# EasyEDA Pro project 智能车.eprj, schematic 霍尔停车检测
Create Date: 2023-10-08; Page Name: P1; Project Name: 智能车; Schematic Name: 霍尔停车检测; Update Date: 2023-10-08; Company: 嘉立创EDA; Page Size: A4; Version: V1.0
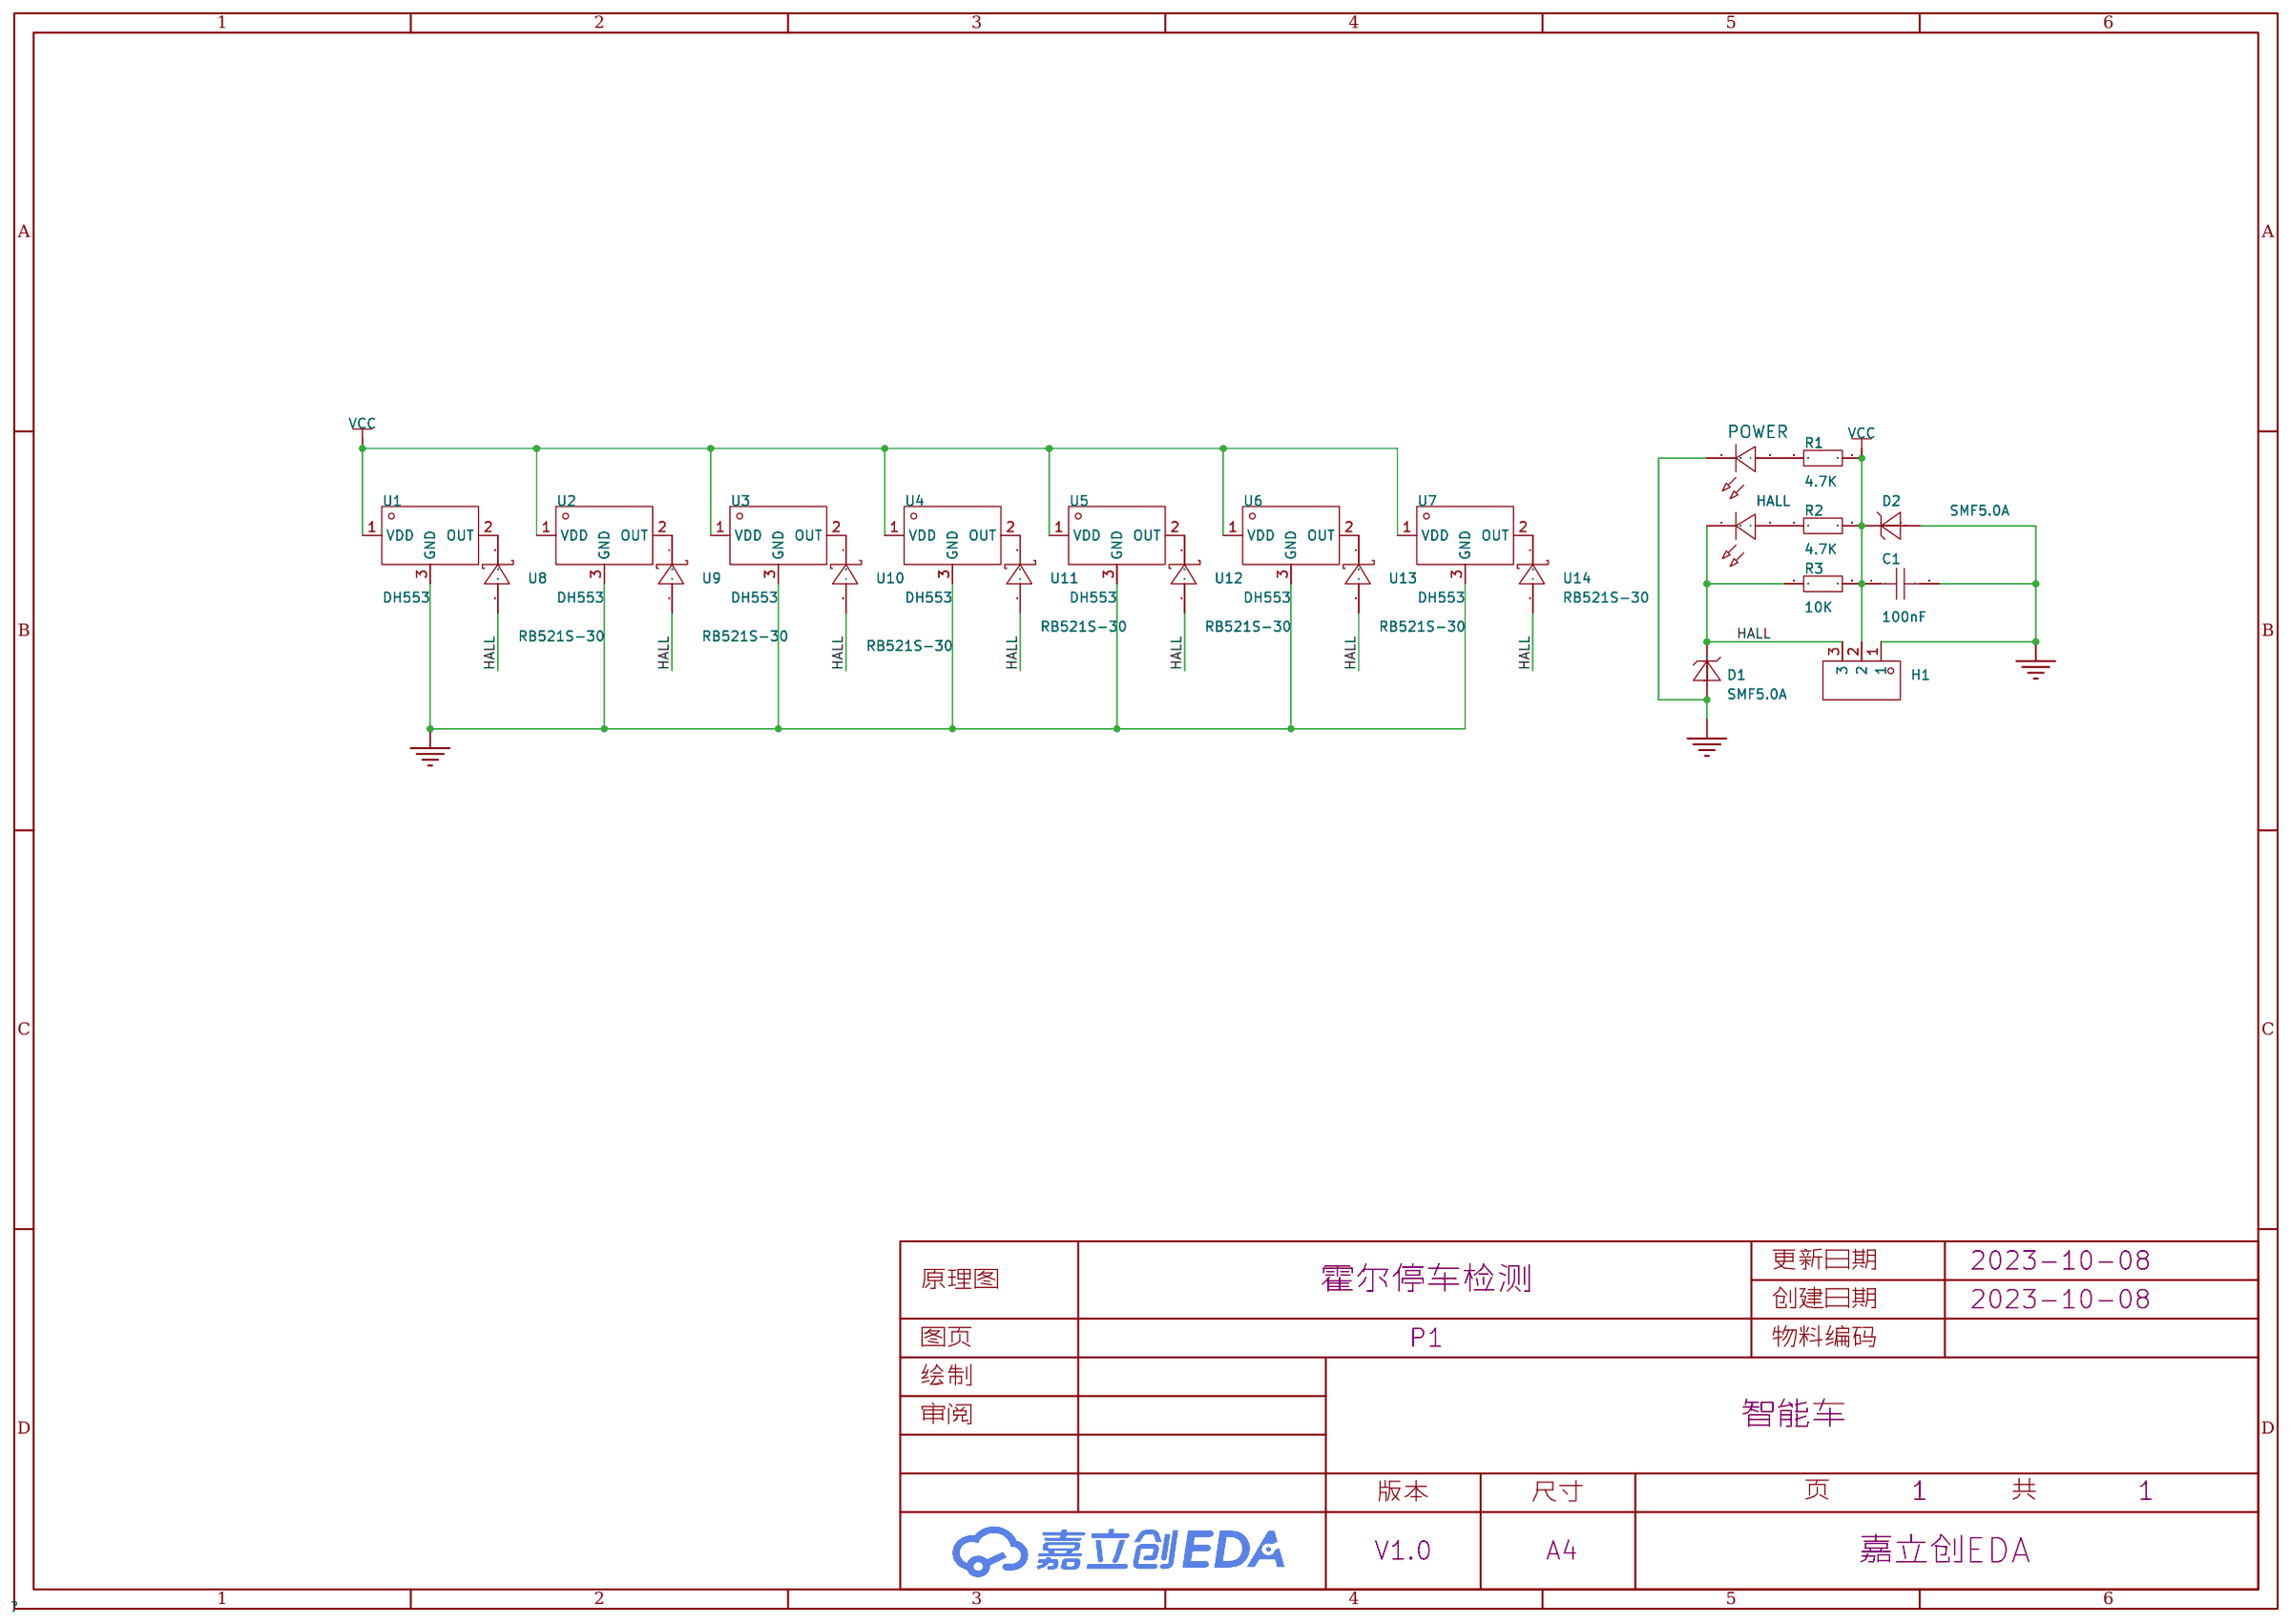
[diagram p3: schematic sheet]

## Parts
C1  100nF  [C0603]
D1  SMF5.0A  [SOD-123FL_L2.7-W1.8-LS3.7-RD]
D2  SMF5.0A  [SOD-123FL_L2.7-W1.8-LS3.7-RD]
H1  -  [HDR-TH_3P-P2.54-V-M]
HALL  -  [LED_0603]
POWER  -  [LED_0603]
R1  4.7K  [R0603]
R2  4.7K  [R0603]
R3  10K  [R0603]
U1  DH553  [SOT-23-3_L2.9-W1.6-P1.90-LS2.8-BR]
U2  DH553  [SOT-23-3_L2.9-W1.6-P1.90-LS2.8-BR]
U3  DH553  [SOT-23-3_L2.9-W1.6-P1.90-LS2.8-BR]
U4  DH553  [SOT-23-3_L2.9-W1.6-P1.90-LS2.8-BR]
U5  DH553  [SOT-23-3_L2.9-W1.6-P1.90-LS2.8-BR]
U6  DH553  [SOT-23-3_L2.9-W1.6-P1.90-LS2.8-BR]
U7  DH553  [SOT-23-3_L2.9-W1.6-P1.90-LS2.8-BR]
U8  RB521S-30  [SOD-523_L1.2-W0.8-LS1.6-RD]
U9  RB521S-30  [SOD-523_L1.2-W0.8-LS1.6-RD]
U10  RB521S-30  [SOD-523_L1.2-W0.8-LS1.6-RD]
U11  RB521S-30  [SOD-523_L1.2-W0.8-LS1.6-RD]
U12  RB521S-30  [SOD-523_L1.2-W0.8-LS1.6-RD]
U13  RB521S-30  [SOD-523_L1.2-W0.8-LS1.6-RD]
U14  RB521S-30  [SOD-523_L1.2-W0.8-LS1.6-RD]

## Library data of the parts
C1 = CAP_0603: Supplier Footprint: 0603
D1 D2 = SMF5.0A_C920173: 反向关断电压（典型值）:-;极性:-;击穿电压（最小值）:-;箝位电压:-;峰值脉冲电流（10/1000us）:-;; Supplier Part: C920173; Manufacturer: Slkor(萨科微); Supplier Footprint: SOD-123FL; JLCPCB Part Class: 扩展库; Datasheet: https://atta.szlcsc.com/upload/public/pdf/source/20201225/C920173_BFD84BF2896AB7D51150E8A3F6CCFD0D.pdf; Supplier: LCSC
H1 = HDR-M_2.54_1x3P: Supplier Part: C2937625; Supplier Footprint: 插件
HALL = LED_0603-B: Supplier Footprint: 0603
POWER = LED_0603-R: Supplier Footprint: 0603
R1-R3 = Res_0603: Supplier Footprint: 0603
U1-U7 = DH553: Supplier Part: C9900017055; Supplier Footprint: SOT-23; JLCPCB Part Class: 扩展库; Datasheet: 2022-05-03/4271220A/db92c3c498684e6880372e0e03084c21/ABUIABA9GAAg2oCe4AUo8ae0wwY.pdf; Supplier: LCSC
U8-U14 = RB521S-30_C609795: Supplier Part: C609795; Manufacturer: Slkor(萨科微); Supplier Footprint: SOD-523; JLCPCB Part Class: 扩展库; Supplier: LCSC

## Nets
GND: C1.2 D1.2 D2.2 H1.1 POWER.1(C) U1.3(GND) U2.3(GND) U3.3(GND) U4.3(GND) U5.3(GND) U6.3(GND) U7.3(GND)
VCC: C1.1 D2.1 H1.2 R1.2 R2.2 R3.2 U1.1(VDD) U2.1(VDD) U3.1(VDD) U4.1(VDD) U5.1(VDD) U6.1(VDD) U7.1(VDD)
HALL: D1.1 H1.3 HALL.1(C) R3.1 U8.2(A) U9.2(A) U10.2(A) U11.2(A) U12.2(A) U13.2(A) U14.2(A)
$1N449: U1.2(OUT) U8.1(C)
$1N481: U2.2(OUT) U9.1(C)
$1N513: U3.2(OUT) U10.1(C)
$1N545: U4.2(OUT) U11.1(C)
$1N577: U5.2(OUT) U12.1(C)
$1N609: U6.2(OUT) U13.1(C)
$1N641: U7.2(OUT) U14.1(C)
$1N1073: POWER.2(A) R1.1
$1N1125: HALL.2(A) R2.1
